# EasyEDA Pro project balance_car.eprj, board PCB1
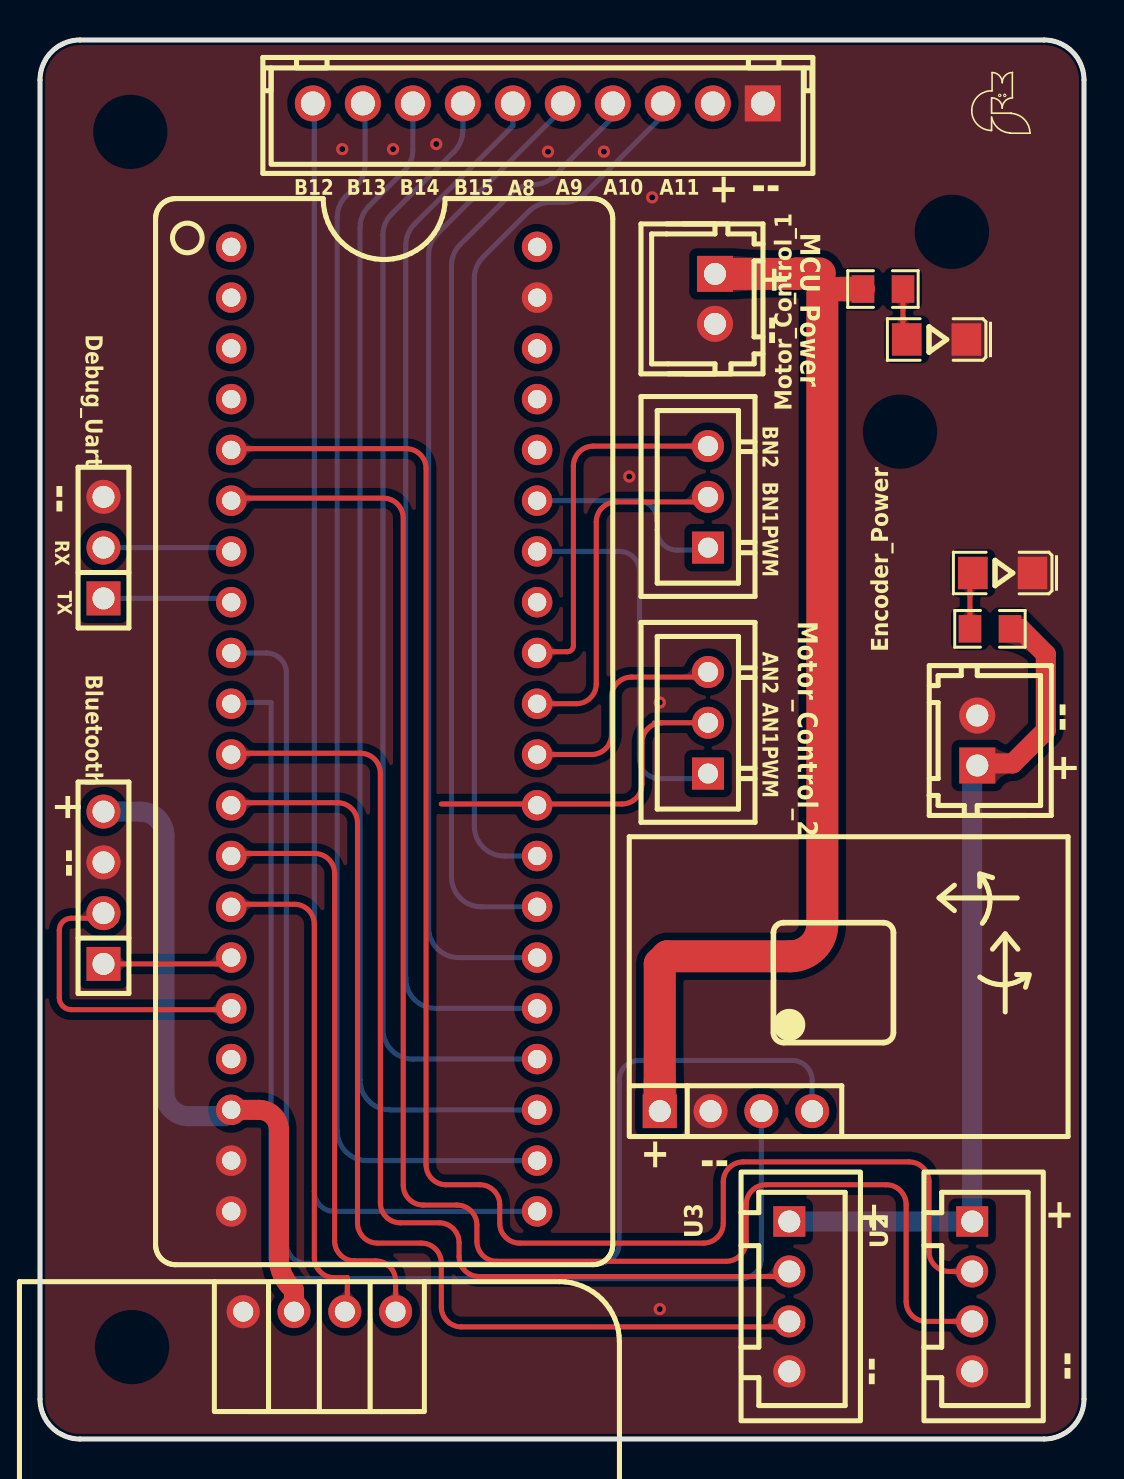
[diagram p10: board, top side]
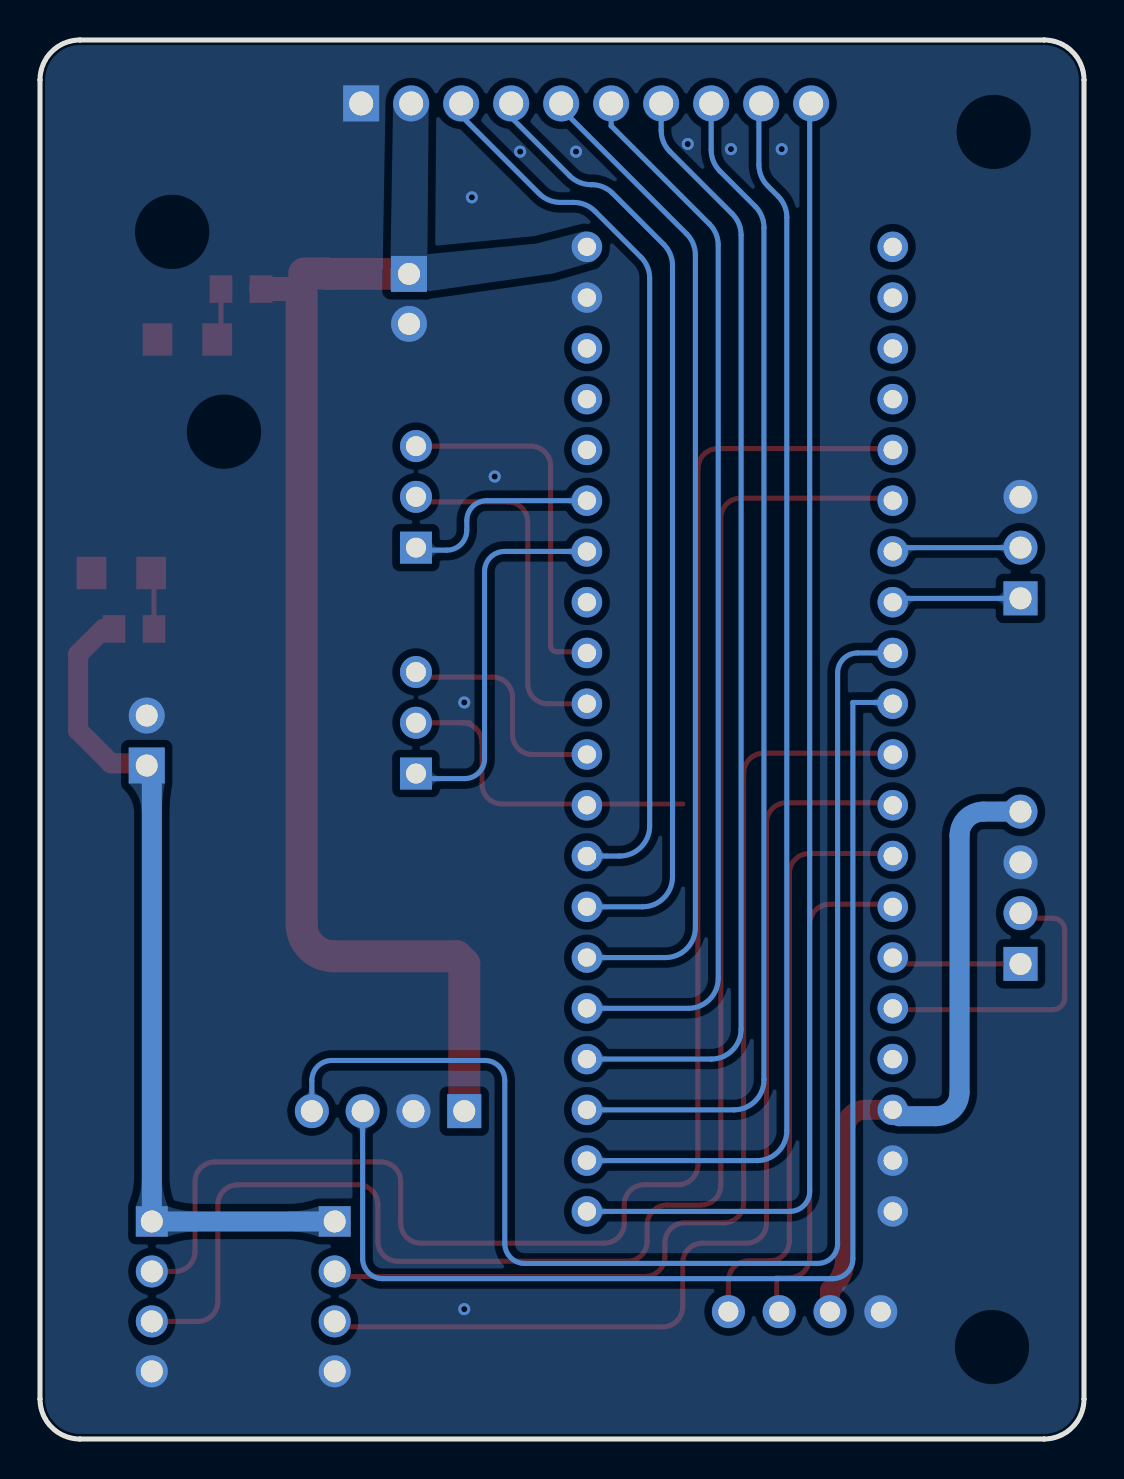
[diagram p11: board, bottom side, seen from below]

Outline 52.2 x 70 mm; copper layers: Top Layer, Bottom Layer. Coordinates in mm from the lower left corner of the outline.
Outline path: 0,68 0,2 arc(0.59,0.59) 2,0 50.2,0 arc(51.61,0.59) 52.2,2 52.2,68 arc(51.61,69.41) 50.2,70 2,70 arc(0.59,69.41) 0,68
Stack: Top Layer 0.035mm / Dielectric1 1.51mm FR4 er 4.5 / Bottom Layer 0.035mm

## Design rules (mm)
net PA1: DP1
net PA0: DP1
template: 自定义配置
spacing copperThickness1oz (default): track to track 0.508, other pairs 0.152 to 0.3
spacing copperThickness2oz: track to track 0.203, other pairs 0.152 to 0.3
track width copperThickness1oz (default): min 0.127, default 0.254, max 2.54
track width copperThickness2oz: min 0.899, default 1.999, max 2.499
differential pair differentialPair (default): width min 0.127, default 0.254, max 2.54; gap min 0.152, default 0.152
via viaSize (default): diameter min 0.5, default 0.61, max 10; hole min 0.3, default 0.305, max 6.299
net GND uses copperThickness2oz, power
net VCC uses copperThickness2oz, power
net VBAT uses copperThickness2oz
net +5V uses copperThickness2oz
net VCC_ENCODER uses copperThickness2oz
pour e4051 uses power

## Placement (name value [footprint] x y rotation side)
CN1  ZX-XH2.54-2PZZ  [CONN-TH_2P-P2.50_HX25003-2A]  33.75 57.05 270 top
CN3  XH-10A  [CONN-TH_10P-P2.50_HCTL_XH-10A]  24.89 66.82 180 top
Encoder_Power  ZX-XH2.54-2PZZ  [CONN-TH_2P-P2.50_HX25003-2A]  46.86 34.95 90 top
H11  UART  [HDR-TH_3P-P2.54-V-M]  3.17 44.6 90 top
LED2  XL-3216SURC  [LED1206-R-RD_RED]  44.83 55.01 180 top
LED3  XL-3216SURC  [LED1206-R-RD_RED]  48.13 43.33 180 top
Motor_Control_1  ZX-XH2.54-3PZZ  [CONN-TH_3P-P2.54_2501S-3P]  33.4 47.14 90 top
OLED1  -  [0.96OLED_4P]  13.97 6.37 0 top
R9  2.2kΩ  [R0805]  42.15 57.54 0 top
R10  2.2kΩ  [R0805]  47.5 40.54 180 top
S  -  [stm32最小开发板]  20.07 34.19 270 top
U2  -  [houer_encoder]  46.61 7.13 270 top
U3  -  [houer_encoder]  37.46 7.13 270 top
U6  -  [bluetooth]  3.17 27.58 90 top
U9  -  [mpu6050_1]  34.8 16.41 180 top
U10  ZX-XH2.54-3PZZ  [CONN-TH_3P-P2.54_2501S-3P]  33.4 35.84 90 top

## Footprints (pads in the part's own frame, mm; a bottom-side part is the same pattern mirrored in y, then rotated)
0.96OLED_4P
  round 1.65 hole 1: 1(-3.81,-0.002) 2(-1.27,0.002) 3(1.27,0.002) 4(3.81,0.002)
bluetooth
  rect 1.7x1.7 hole 1.1: 1(-3.81,0)
  round 1.7 hole 1.1: 2(-1.27,0) 3(1.27,0) 4(3.81,0)
CONN-TH_2P-P2.50_HX25003-2A
  rect 1.8x1.8 hole 1.1: 1(-1.25,0)
  round 1.8 hole 1.1: 2(1.25,0)
CONN-TH_3P-P2.54_2501S-3P
  rect 1.6x1.6 hole 1: 1(-2.54,0)
  round 1.6 hole 1: 2(0,0) 3(2.54,0)
CONN-TH_10P-P2.50_HCTL_XH-10A
  rect 1.8x1.8 hole 1.2: 1(-11.25,0)
  round 1.8 hole 1.2: 2(-8.75,0) 3(-6.25,0) 4(-3.75,0) 5(-1.25,0) 6(1.25,0) 7(3.75,0) 8(6.25,0) 9(8.75,0) 10(11.25,0)
HDR-TH_3P-P2.54-V-M
  rect 1.7x1.7 hole 1.1: 1(-2.54,0)
  round 1.7 hole 1.1: 2(0,0) 3(2.54,0)
houer_encoder
  rect 1.524x1.6 hole 1.1: 1(-3.75,0)
  round 1.6 hole 1.1: 2(-1.25,0) 3(1.25,0) 4(3.75,0)
LED1206-R-RD_RED
  rect 1.485x1.62 smd: 1(1.492,0) 2(-1.492,0)
mpu6050_1
  rect 1.7x1.7 hole 1.1: 1(3.81,0)
  round 1.7 hole 1.1: 2(1.27,0) 3(-1.27,0) 4(-3.81,0)
R0805
  rect 1.133x1.377 smd: 1(-1,0) 2(1,0)
stm32最小开发板
  round 1.524 hole 0.914: 1(-25.463,-10.504) 2(-22.924,-10.504) 3(-20.384,-10.504) 4(-17.843,-10.504) 5(-15.303,-10.504) 6(-12.764,-10.504) 7(-10.223,-10.504) 8(-7.684,-10.504) 9(-5.144,-10.504) 10(-2.603,-10.504) 11(-0.064,-10.504) 12(2.477,-10.504) 13(5.016,-10.504) 14(7.556,-10.504) 15(10.097,-10.504) 16(12.636,-10.504) 17(15.177,-10.504) 18(17.716,-10.504) 19(20.256,-10.504) 20(22.797,-10.504) 21(-25.463,4.789) 22(-22.924,4.789) 23(-20.384,4.789) 24(-17.843,4.789) 25(-15.303,4.789) 26(-12.764,4.789) 27(-10.223,4.789) 28(-7.684,4.789) 29(-5.144,4.789) 30(-2.603,4.789) 31(-0.064,4.789) 32(2.477,4.789) 33(5.016,4.789) 34(7.556,4.789) 35(10.097,4.789) 36(12.636,4.789) 37(15.177,4.789) 38(17.716,4.789) 39(20.256,4.789) 40(22.797,4.789)

## Nets
As in the schematic, except:
GND: CN1.2 CN3.1 Encoder_Power.2 H11.3 LED2.2 LED3.2 OLED1.1 S.19 S.20 S.22 U2.4 U3.4 U6.3 U9.2
VCC_2: OLED1.2 S.18 U6.4
VCC_ENCODER: Encoder_Power.1 R10.1 U2.1 U3.1
PB0: OLED1.4 S.13
PB1: OLED1.3 S.14
PB3: Motor_Control_1.2 S.30
PB4: Motor_Control_1.3 S.29
PB7: Motor_Control_1.1 S.26

## Via types
v1: diameter 0.61, hole 0.305, Top Layer to Bottom Layer, 9 vias

## Routing (per net, layer and track width the routed paths; a pad name or vN(x,y) marks a point on that pad's centre or on a via; arc(x,y) is an arc through that point)
GND:
  vias: v1(15.11,64.54) v1(17.65,64.54) v1(19.81,64.79) v1(25.4,64.41) v1(28.19,64.41) v1(29.46,48.16) v1(30.61,62.13) v1(30.99,36.85) v1(30.99,6.5)
VCC: length 55.3
  Top Layer w1.2: 39.24,57.54 R9.1
  Top Layer w1.6: 39.12,57.3 39.12,25.75 arc(38.65,24.62) 37.52,24.15 31.37,24.15 30.99,23.77 U9.1 ; 38.99,58.32 37.85,58.32 37.83,58.3 CN1.1
VCC_2: length 33
  Top Layer w1: S.18 10.95,16.47 arc(11.65,16.18) 11.95,15.47 11.95,9.07 arc(12.14,8.18) 12.7,7.45 OLED1.2
  Bottom Layer w1: U6.4 5.02,31.39 arc(5.87,31.04) 6.22,30.19 6.22,17.35 arc(6.57,16.5) 7.42,16.15 9.24,16.15 S.18
VCC_ENCODER: length 42.3
  Top Layer w1: R10.1 49.02,40.54 50.29,39.27 50.29,35.46 48.64,33.8 46.97,33.8 Encoder_Power.1
  Bottom Layer w1: Encoder_Power.1 46.61,33.44 U2.1 U3.1
PA0: length 83
  Top Layer w0.254: 10.2,49.62 10.2,49.55 18.3,49.55 arc(19.01,49.26) 19.3,48.55 19.3,13.72 arc(19.6,13.02) 20.3,12.72 21.99,12.72 arc(22.69,12.43) 22.99,11.72 22.99,10.8 arc(23.28,10.09) 23.99,9.8 33.16,9.8 arc(33.87,10.09) 34.16,10.8 34.16,12.87 arc(34.46,13.57) 35.16,13.87 43.45,13.87 arc(44.16,13.57) 44.45,12.87 44.45,9.38 arc(44.74,8.68) 45.45,8.38 47.24,8.38
PA1: length 82.5
  Top Layer w0.254: 47.24,5.88 44.31,5.88 arc(43.6,6.18) 43.31,6.88 43.31,11.72 arc(43.01,12.43) 42.31,12.72 36.31,12.72 arc(35.6,12.43) 35.31,11.72 35.31,9.89 arc(35.01,9.19) 34.31,8.89 22.84,8.89 arc(22.14,9.19) 21.84,9.89 21.84,10.71 arc(21.55,11.41) 20.84,11.71 19.16,11.71 arc(18.45,12) 18.16,12.71 18.16,46.08 arc(17.87,46.78) 17.16,47.08 10.2,47.08
PA2: length 7.4
  Top Layer w0.254: 2.54,44.6 H11.2
  Bottom Layer w0.254: S.7 9.37,44.6 2.92,44.6
PA3: length 6.7
  Bottom Layer w0.254: 2.92,42.06 9.37,42.06 S.8
PA4: length 70.1
  Bottom Layer w0.254: U9.4 38.61,17.94 arc(38.32,18.65) 37.61,18.94 29.96,18.94 arc(29.25,18.65) 28.96,17.94 28.96,9.79 arc(28.67,9.08) 27.96,8.79 13.32,8.79 arc(12.61,9.08) 12.32,9.79 12.32,38.33 arc(12.03,39.04) 11.32,39.33 S.9
PA5: length 62.9
  Bottom Layer w0.254: S.10 9.56,36.85 11.56,36.85 11.56,9.02 arc(11.85,8.32) 12.56,8.02 35.07,8.02 arc(35.78,8.32) 36.07,9.02 U9.3
PA6: length 52.5
  Top Layer w0.254: 10.2,34.38 10.2,34.31 16.02,34.31 arc(16.73,34.02) 17.02,33.31 17.02,11.82 arc(17.31,11.11) 18.02,10.82 19.95,10.82 arc(20.66,10.53) 20.95,9.82 20.95,9.13 arc(21.25,8.42) 21.95,8.13 37.85,8.13 38.1,8.38
PA7: length 52.7
  Top Layer w0.254: 10.2,31.84 14.88,31.84 arc(15.58,31.54) 15.88,30.84 15.88,10.8 arc(16.17,10.09) 16.88,9.8 19.07,9.8 arc(19.77,9.51) 20.07,8.8 20.07,6.61 arc(20.36,5.9) 21.07,5.61 38.1,5.61 38.1,5.88
PA8: length 53.1
  Bottom Layer w0.254: 24.86,21.55 19.79,21.55 arc(18.73,21.99) 18.29,23.05 18.29,59.73 arc(18.4,60.3) 18.73,60.79 23.64,65.7 23.64,66.57
PA9/TX: length 50
  Bottom Layer w0.254: 24.86,24.09 20.93,24.09 arc(19.87,24.53) 19.43,25.59 19.43,59.24 arc(19.55,59.81) 19.87,60.3 26.14,66.57
PA10/RX: length 47.5
  Bottom Layer w0.254: 28.64,66.57 28.64,66.13 25.71,63.2 arc(25.23,62.88) 24.65,62.76 24.62,62.76 arc(24.05,62.65) 23.56,62.32 21.01,59.77 arc(20.69,59.28) 20.57,58.71 20.57,28.13 arc(21.01,27.07) 22.07,26.63 24.86,26.63
PA11: length 44.7
  Bottom Layer w0.254: 31.14,66.57 31.14,66.21 27.24,62.31 arc(26.75,61.99) 26.18,61.87 25.51,61.87 arc(24.94,61.76) 24.45,61.43 22.16,59.14 arc(21.83,58.65) 21.72,58.08 21.72,30.67 arc(22.16,29.61) 23.22,29.17 24.86,29.17
PA12: length 17
  Top Layer w0.254: 24.86,31.77 29.1,31.77 arc(29.81,32.07) 30.1,32.77 30.1,34.84 arc(30.39,35.54) 31.1,35.84 ; 24.86,31.77 20.07,31.77 ; 24.86,31.77 24.86,31.71 ; 31.1,35.84 30.72,35.84 ; 31.1,35.84 U10.2
PA15: length 11.8
  Top Layer w0.254: 24.86,34.25 27.58,34.25 arc(28.28,34.54) 28.58,35.25 28.58,37.12 arc(28.87,37.83) 29.58,38.12 33.4,38.12 U10.3
PB0: length 29.5
  Top Layer w0.254: 10.2,29.3 13.73,29.3 arc(14.44,29) 14.73,28.3 14.73,9.91 arc(15.02,9.21) 15.73,8.91 ; 15.73,8.91 16.78,8.91 arc(17.49,8.62) 17.78,7.91 OLED1.4 ; 15.73,8.91 15.48,8.91
PB1: length 24.9
  Top Layer w0.254: 10.2,26.76 12.72,26.76 arc(13.42,26.46) 13.72,25.76 13.72,9.07 arc(14.01,8.37) 14.72,8.07 15.37,8.07 15.37,6.88 15.88,6.37
PB3: length 18
  Top Layer w0.254: Motor_Control_1.2 33.4,46.89 28.81,46.89 arc(28.11,46.59) 27.81,45.89 27.81,37.79 arc(27.52,37.08) 26.81,36.79 24.86,36.79
PB4: length 18.3
  Top Layer w0.254: Motor_Control_1.3 27.67,49.68 arc(26.96,49.39) 26.67,48.68 26.67,39.69 arc(26.58,39.48) 26.37,39.39 24.86,39.39 24.86,39.33
PB6: length 19.3
  Bottom Layer w0.254: 24.86,44.41 28.97,44.41 arc(29.68,44.12) 29.97,43.41 29.97,34.04 arc(30.26,33.34) 30.97,33.04 33.4,33.04 U10.1
PB7: length 10.2
  Bottom Layer w0.254: 24.86,46.95 29.86,46.95 arc(30.57,46.66) 30.86,45.95 30.86,45.47 arc(31.15,44.77) 31.86,44.47 33.4,44.47
PB10: length 6.5
  Top Layer w0.254: U6.1 9.24,23.77 S.15
PB11: length 15
  Top Layer w0.254: S.16 9.49,21.48 1.56,21.48 arc(1.14,21.66) 0.96,22.08 0.96,25.46 arc(1.14,25.88) 1.56,26.06 2.92,26.06 U6.2
PB12: length 65.9
  Bottom Layer w0.254: 13.64,66.57 13.72,66.5 13.72,12.39 arc(14.01,11.68) 14.72,11.39 24.86,11.39
PB13: length 62.5
  Bottom Layer w0.254: 16.14,66.57 16.26,66.46 16.26,63.76 arc(16.14,63.19) 15.82,62.7 15.3,62.18 arc(14.97,61.7) 14.86,61.12 14.86,15.43 arc(15.3,14.37) 16.36,13.93 24.86,13.93
PB14: length 59
  Bottom Layer w0.254: 24.86,16.47 17.5,16.47 arc(16.44,16.91) 16,17.97 16,60.62 arc(16.12,61.19) 16.44,61.68 18.2,63.44 arc(18.53,63.92) 18.64,64.5 18.64,66.29
PB15: length 56.2
  Bottom Layer w0.254: 21.14,66.57 21.14,65.47 arc(21.03,64.9) 20.7,64.41 17.58,61.3 arc(17.26,60.81) 17.14,60.23 17.14,20.51 arc(17.58,19.45) 18.64,19.01 24.86,19.01
$1N8194: length 3
  Top Layer w0.254: 43.15,58.05 43.15,55.52 43.49,55.18
$1N8288: length 2.7
  Top Layer w0.254: R10.2 46.5,43.06 46.64,43.2

## Copper pours and planes (outline as drawn; the poured copper is in the pictures)
GND on Top Layer: -2.67,72.16 59.94,72.16 59.94,-6.96 -2.67,-6.96
GND on Bottom Layer: -1.91,73.94 63.75,73.94 63.75,-2.14 -1.91,-2.14
VCC on Bottom Layer: 34.57,59.11 27.43,59.8 24.99,60.44 24.51,60.35 24.26,60.09 24.13,59.84 24.13,59.36 24.51,58.91 26.54,58.32 32.77,57.43
VCC on Bottom Layer: 32.85,57.43 32.77,66.7 32.89,67.08 33.4,67.46 33.91,67.46 34.29,67.21 34.54,66.84 34.7,57.43

Small or netless copper shapes (teardrops, artwork), in the pictures only: 33 on Top Layer, 26 on Bottom Layer

## Text on the board
Top Silkscreen Layer: RX | TX | BN2 | BN1 | PWM | AN2 | AN1 | B12 | B13 | B14 | B15 | A8 | A9 | A10 | A11 | Debug_Uart | Bluetooth | Motor_Control_2 | MCU_Power | -- | +
